# EasyEDA Pro project SuperCapTestBoard - copy - 2 25.eprj (continued)
## Parts (continued)

## Library data of the parts
C1 C2 C10 C14 C21 C22 C25-C33 C36-C43 CFF1 = CAP_0603: Supplier Footprint: 0603
C3 = C_Ele_SMD_3x5.4mm: Supplier Footprint: SMD,3x5.4mm; 耐压: 35V
C4-C9 C12 C13 C16-C20 = C_Ele_SMD_3x5.4mm: Supplier Footprint: SMD,3x5.4mm
C11 C15 C23 C24 = CAP_0201: Supplier Footprint: 0201
CN1-CN3 = XT30U-M: LCSC Part Name: AMASS(艾迈斯)轻量版锂电池插头公头 XT30U-M; Supplier Part: C99101; Manufacturer: AMASS(艾迈斯); JLCPCB Part Class: Extended Part; Datasheet: https://atta.szlcsc.com/upload/public/pdf/source/20170606/1496716542582.pdf; Supplier: LCSC
D1-D4 = 1N4007: Supplier Footprint: DO-41
L1 L2 = L_0603: Supplier Footprint: L0603
Q1-Q6 = NCEP0178AK: Gate Threshold Voltage (Vgs(th)@Id):2.2V@250uA Drain Source Voltage (Vdss): Continuous Drain Current (Id): Power Dissipation (Pd): Type: Drain Source On Resistance (RDS(on)@Vgs,Id):8.5mΩ@10V,39A; LCSC Part Name: N沟道 耐压:100V 电流:78A; Supplier Part: C216784; Manufacturer: NCE(无锡新洁能); Supplier Footprint: TO-252-2(DPAK); JLCPCB Part Class: Extended Part; Datasheet: https://atta.szlcsc.com/upload/public/pdf/source/20180614/C216784_4CC9571F208305EE00914CFFBA9F145C.pdf; Supplier: LCSC; Gate Threshold Voltage (Vgs(th)@Id): 2.2V@250uA; Drain Source On Resistance (RDS(on)@Vgs,Id): 8.5mΩ@10V,39A
R1 R2 R11 = LR2512D-3W-5mR-1%: Type:Current Sensing Resistors Resistance:5mΩ Tolerance:±1% Tolerance:±1% Power(Watts): Temperature Coefficient:25ppm/℃~+50ppm/℃ Temperature Coefficient:25ppm/℃~+50ppm/℃ Mounting Sytle:Surface Mount; LCSC Part Name: 5mΩ ±1% 3W; Supplier Part: C500739; Manufacturer: Milliohm(毫欧); Supplier Footprint: 2512; JLCPCB Part Class: Extended Part; Datasheet: https://atta.szlcsc.com/upload/public/pdf/source/20211008/27BCB003066C6550DC06C87D8395239C.pdf; Supplier: LCSC; Type: Current Sensing Resistors; Tolerance: ±1%; Temperature Coefficient: 25ppm/℃~+50ppm/℃; Mounting Sytle: Surface Mount
R3-R10 R12-R16 R18 R20-R28 R31 R32 = Res_0603: Supplier Footprint: 0603
R17 R19 = Res_0201: Supplier Footprint: 0201
U1 = LM5050MK-1/NOPB: Supplier Part: C129323; Manufacturer: TI(德州仪器); Supplier Footprint: TSOT-23-6; JLCPCB Part Class: Extended Part; Datasheet: https://atta.szlcsc.com/upload/public/pdf/source/20170914/C129323_1505359957620968163.pdf; Supplier: LCSC
U2 U4 = SB1045L_C2844167: Diode Configuration:Single Forward Voltage (Vf@If):400mV@8A Reverse Voltage (Vr):45V Average Rectified Current (Io):10A Reverse Leakage Current (Ir):51uA@45V; LCSC Part Name: 电压:45V 电流:10A; Supplier Part: C2844167; Manufacturer: FUXINSEMI(富芯森美); Supplier Footprint: TO-277B; JLCPCB Part Class: 扩展库; Datasheet: https://atta.szlcsc.com/upload/public/pdf/source/20220513/1E1CA09FD724AFD607AAA472FAD2B52D.pdf; Supplier: LCSC; Diode Configuration: Single; Forward Voltage (Vf@If): 400mV@8A; Reverse Voltage (Vr): 45V; Average Rectified Current (Io): 10A; Reverse Leakage Current (Ir): 51uA@45V
U3 U5 = UCC27284QDRQ1: Driven Configuration:Half Bridge Number of Drivers:2 Load Type:MOSFET Supply Voltage:5.5V~16V Supply Voltage:5.5V~16V Peak Output Current(sink):3.5A Peak Output Current(source):2.5A Rise Time:12ns Fall Time:10ns Operating Temperature:-40℃~+125℃ Operating; LCSC Part Name: 半桥 MOSFET 灌电流3.5A 拉电流2.5A; Supplier Part: C3654891; Manufacturer: TI(德州仪器); Supplier Footprint: SOIC-8; JLCPCB Part Class: 扩展库; Supplier: LCSC; Driven Configuration: Half Bridge; Number of Drivers: 2; Load Type: MOSFET; Supply Voltage: 5.5V~16V; Peak Output Current(sink): 3.5A; Peak Output Current(source): 2.5A; Rise Time: 12ns; Fall Time: 10ns; Operating Temperature: -40℃~+125℃
C34 C35 = TAJA106K016RNJ: Capacitance: Tolerance:±10% Tolerance:±10% Rated Voltage: Equivalent Series Resistance(ESR):3Ω@100kHz Operating Temperature:-55℃~+125℃ Operating Temperature:-55℃~+125℃; LCSC Part Name: 10uF ±10% 16V; Supplier Part: C7171; Manufacturer: Kyocera AVX; Supplier Footprint: CASE-A-3216; JLCPCB Part Class: 基础库; Datasheet: https://atta.szlcsc.com/upload/public/pdf/source/20160107/1457707748093.pdf; Supplier: LCSC; Tolerance: ±10%; Equivalent Series Resistance(ESR): 3Ω@100kHz; Operating Temperature: -55℃~+125℃
D5 = D_1N4007: Supplier Footprint: SMA
U6 = SY8501FCC: Supplier Part: C365714; Manufacturer: silergy(矽力杰); Supplier Footprint: SO-8-EP; JLCPCB Part Class: 扩展库; Datasheet: https://atta.szlcsc.com/upload/public/pdf/source/20190322/C365714_219A6278F83EB450AA6BA842D4F40851.pdf; Supplier: LCSC
U7 = LM1117DTX-3.3/NOPB: Supplier Part: C78471; Supplier Footprint: TO-252-2(DPAK); JLCPCB Part Class: 扩展库; Datasheet: https://atta.szlcsc.com/upload/public/pdf/source/20160718/1468827476469.pdf; Supplier: LCSC
H1 H3-H8 = HDR-F_2.54_1x2P: Supplier Footprint: Through
H2 = HDR-F_2.54_1x2P: Supplier Part: C49661; Supplier Footprint: 插件
L3 = L_0805
R29 = Res_0603: V_bat; Supplier Footprint: 0603
R30 = Res_0603: V_cap; Supplier Footprint: 0603
U8 U10 = INA181A1IDBVT: I_Left; Supplier Part: C2861997; Manufacturer: TI(德州仪器); Supplier Footprint: SOT-23-6; JLCPCB Part Class: 扩展库; Supplier: LCSC
U9 = INA181A1IDBVT: I_Right; Supplier Part: C2861997; Manufacturer: TI(德州仪器); Supplier Footprint: SOT-23-6; JLCPCB Part Class: 扩展库; Supplier: LCSC
U11 = TLV521DCKR: 1V65 Op_amp; Supplier Part: C655085; Manufacturer: TI(德州仪器); Supplier Footprint: SC-70-5; JLCPCB Part Class: 扩展库; Datasheet: https://atta.szlcsc.com/upload/public/pdf/source/20230221/E2B5CB4AD3C2600A011813BFD55EDD6A.pdf; Supplier: LCSC

## Nets
1V65: C41.1 C42.1 C43.1 U8.5(REF) U9.5(REF) U10.5(REF) U11.1(OUT) U11.4(IN-)
3V3: C35.1 L3.1 U7.2(OUT)
12V: C1.2 C14.2 C30.2 C31.2 C32.2 C34.1 CFF1.2 D5.2(A) L2.2 R17.2 R19.2 R24.2 U3.1(VDD) U5.1(VDD) U7.3(IN)
24V: C26.2 C27.2 C28.2 CN2.1 R11.2 R23.1 R25.2 U6.2(IN) U8.3(IN+)
GND: C1.1 C3.2 C4.2 C5.2 C6.2 C7.2 C8.2 C9.2 C11.2 C12.2 C13.2 C14.1 C15.2 C16.2 C17.2 C18.2 C19.2 C20.2 C23.2 C24.2 C26.1 C27.1 C28.1 C29.1 C30.1 C31.1 C32.1 C33.2 C34.2 C35.2 C36.2 C37.2 C38.2 C39.2 C40.2 C41.2 C42.2 C43.2 CN1.2 CN2.2 CN3.2 H1.2 H2.1 H2.2 H3.2 H4.2 H5.2 H8.2 Q5.3(S) Q6.3(S) R14.1 R15.1 R16.2 R26.1 R28.1 R31.1 R32.1 U1.2(GND) U3.7(VSS) U5.7(VSS) U6.9(GND) U7.1(GND) U8.2(GND) U9.2(GND) U10.2(GND) U11.2(V-)
ADC12_IN0: H1.1 U8.1(OUT)
ADC12_IN1: H3.1 U10.1(OUT)
ADC12_IN2: H4.1 U9.1(OUT)
ADC12_IN3: H5.1 R29.1 R31.2
ADC12_IN4: H8.1 R30.1 R32.2
ChassisPower: CN1.1 Q3.4(D) Q4.4(D) R1.2 R29.2 U1.1(VS) U1.6(OUT) U10.3(IN+)
DCDCOutput-CAP: CN3.1 R2.2 R30.2 U9.3(IN+)
I_Bat_TP_L: C3.1 C4.1 C5.1 C6.1 C7.1 C8.1 C9.1 Q1.4(D) R1.1 U10.4(IN-)
I_Cap_TP_L: C12.1 C13.1 C16.1 C17.1 C18.1 C19.1 C20.1 Q2.4(D) R2.1 U9.4(IN-)
I_Sys_TP_L: Q3.3(S) Q4.3(S) R11.1 U1.4(IN) U8.4(IN-)
LHG: R3.1 R5.1 U5.3(HO)
LHG_Control: H7.1 R22.2
LHGND: C21.2 C22.2 L1.1 Q1.3(S) Q5.4(D) R7.1 U5.4(HS)
LLG: R9.1 R12.1 U5.8(LO)
LLG_Control: H7.2 R21.2
REF3V3: C36.1 C37.1 C38.1 C39.1 L3.2 R27.2 U8.6(VS) U9.6(VS) U10.6(VS) U11.5(V+)
RHG: R4.1 R6.1 U3.3(HO)
RHG_Control: H6.1 R20.2
RHGND: C2.2 C10.2 L1.2 Q2.3(S) Q6.4(D) R8.1 U3.4(HS)
RLG: R10.1 R13.1 U3.8(LO)
RLG_Control: H6.2 R18.2
$1N1327: R16.1 U1.3(OFF)
$1N6258: D1.1(K) R3.2
$1N6388: D1.2(A) Q1.1(G) R5.2 R7.2
$1N6557: D3.1(K) R9.2
$1N6577: D3.2(A) Q5.1(G) R12.2 R14.2
$1N6908: D2.1(K) R4.2
$1N6911: D4.1(K) R10.2
$1N6922: D2.2(A) Q2.1(G) R6.2 R8.2
$1N6941: D4.2(A) Q6.1(G) R13.2 R15.2
$1N7206: C11.1 R18.1 U3.6(LI)
$1N7273: C15.1 R20.1 U3.5(HI)
$1N7440: C23.1 R21.1 U5.6(LI)
$1N7452: C24.1 R22.1 U5.5(HI)
$1N7629: Q3.1(G) Q4.1(G) U1.5(GATE)
$1N10834: C2.1 C10.1 U2.2 U3.2(HB)
$1N10869: C21.1 C22.1 U4.2 U5.2(HB)
$1N10964: R19.1 U4.1 U4.3
$1N11017: R17.1 U2.1 U2.3
$2N706: C25.1 U6.7(BS)
$2N707: C29.2 R23.2 U6.3(EN)
$2N709: C33.1 D5.1(K) U6.6(VCC)
$2N715: R25.1 U6.4(RON)
$2N718: C25.2 L2.1 U6.8(LX)
$2N719: CFF1.1 R24.1 R26.2 U6.5(FB)
$3N6491: C40.1 R27.1 R28.2 U11.3(IN+)

Not connected (* = marked no-connect by the designer): U6 1(NC)*

## Notes on the sheets
sheet 1
- Estimation Power in this resistor: 1W
  Max current: 10A -10A
- Estimation Power in this resistor: 2W
  Max current: 15A -15A
- Estimation Power in this resistor: 1W
  Max current: 10A
- change to 220nF & 2R2 in the test board
sheet 2
- Input 24V
- Change to 10k and 91k
- DC voltage for C is 35
- Power
- 24V -DCDC-> 12V -LDO-> 5V -LDO-> 3V3
- Output current ?
- Output 12V
- The C will be change to low ESR
- The C will be change to low ESR
- This page leave for MCU (STM32F4)
sheet 3
- GPIO and GND
- -15A to 15A , typ 0A -> 0.075Vto-0.075V
- 0.075Vto-0.075V  ===>  *20+1.65
- 0.05Vto-0.05V  ===>   *20+1.65
- 0 to 30V, typ 24V
- 0 to 30V, typ 24V

# Board PCB1
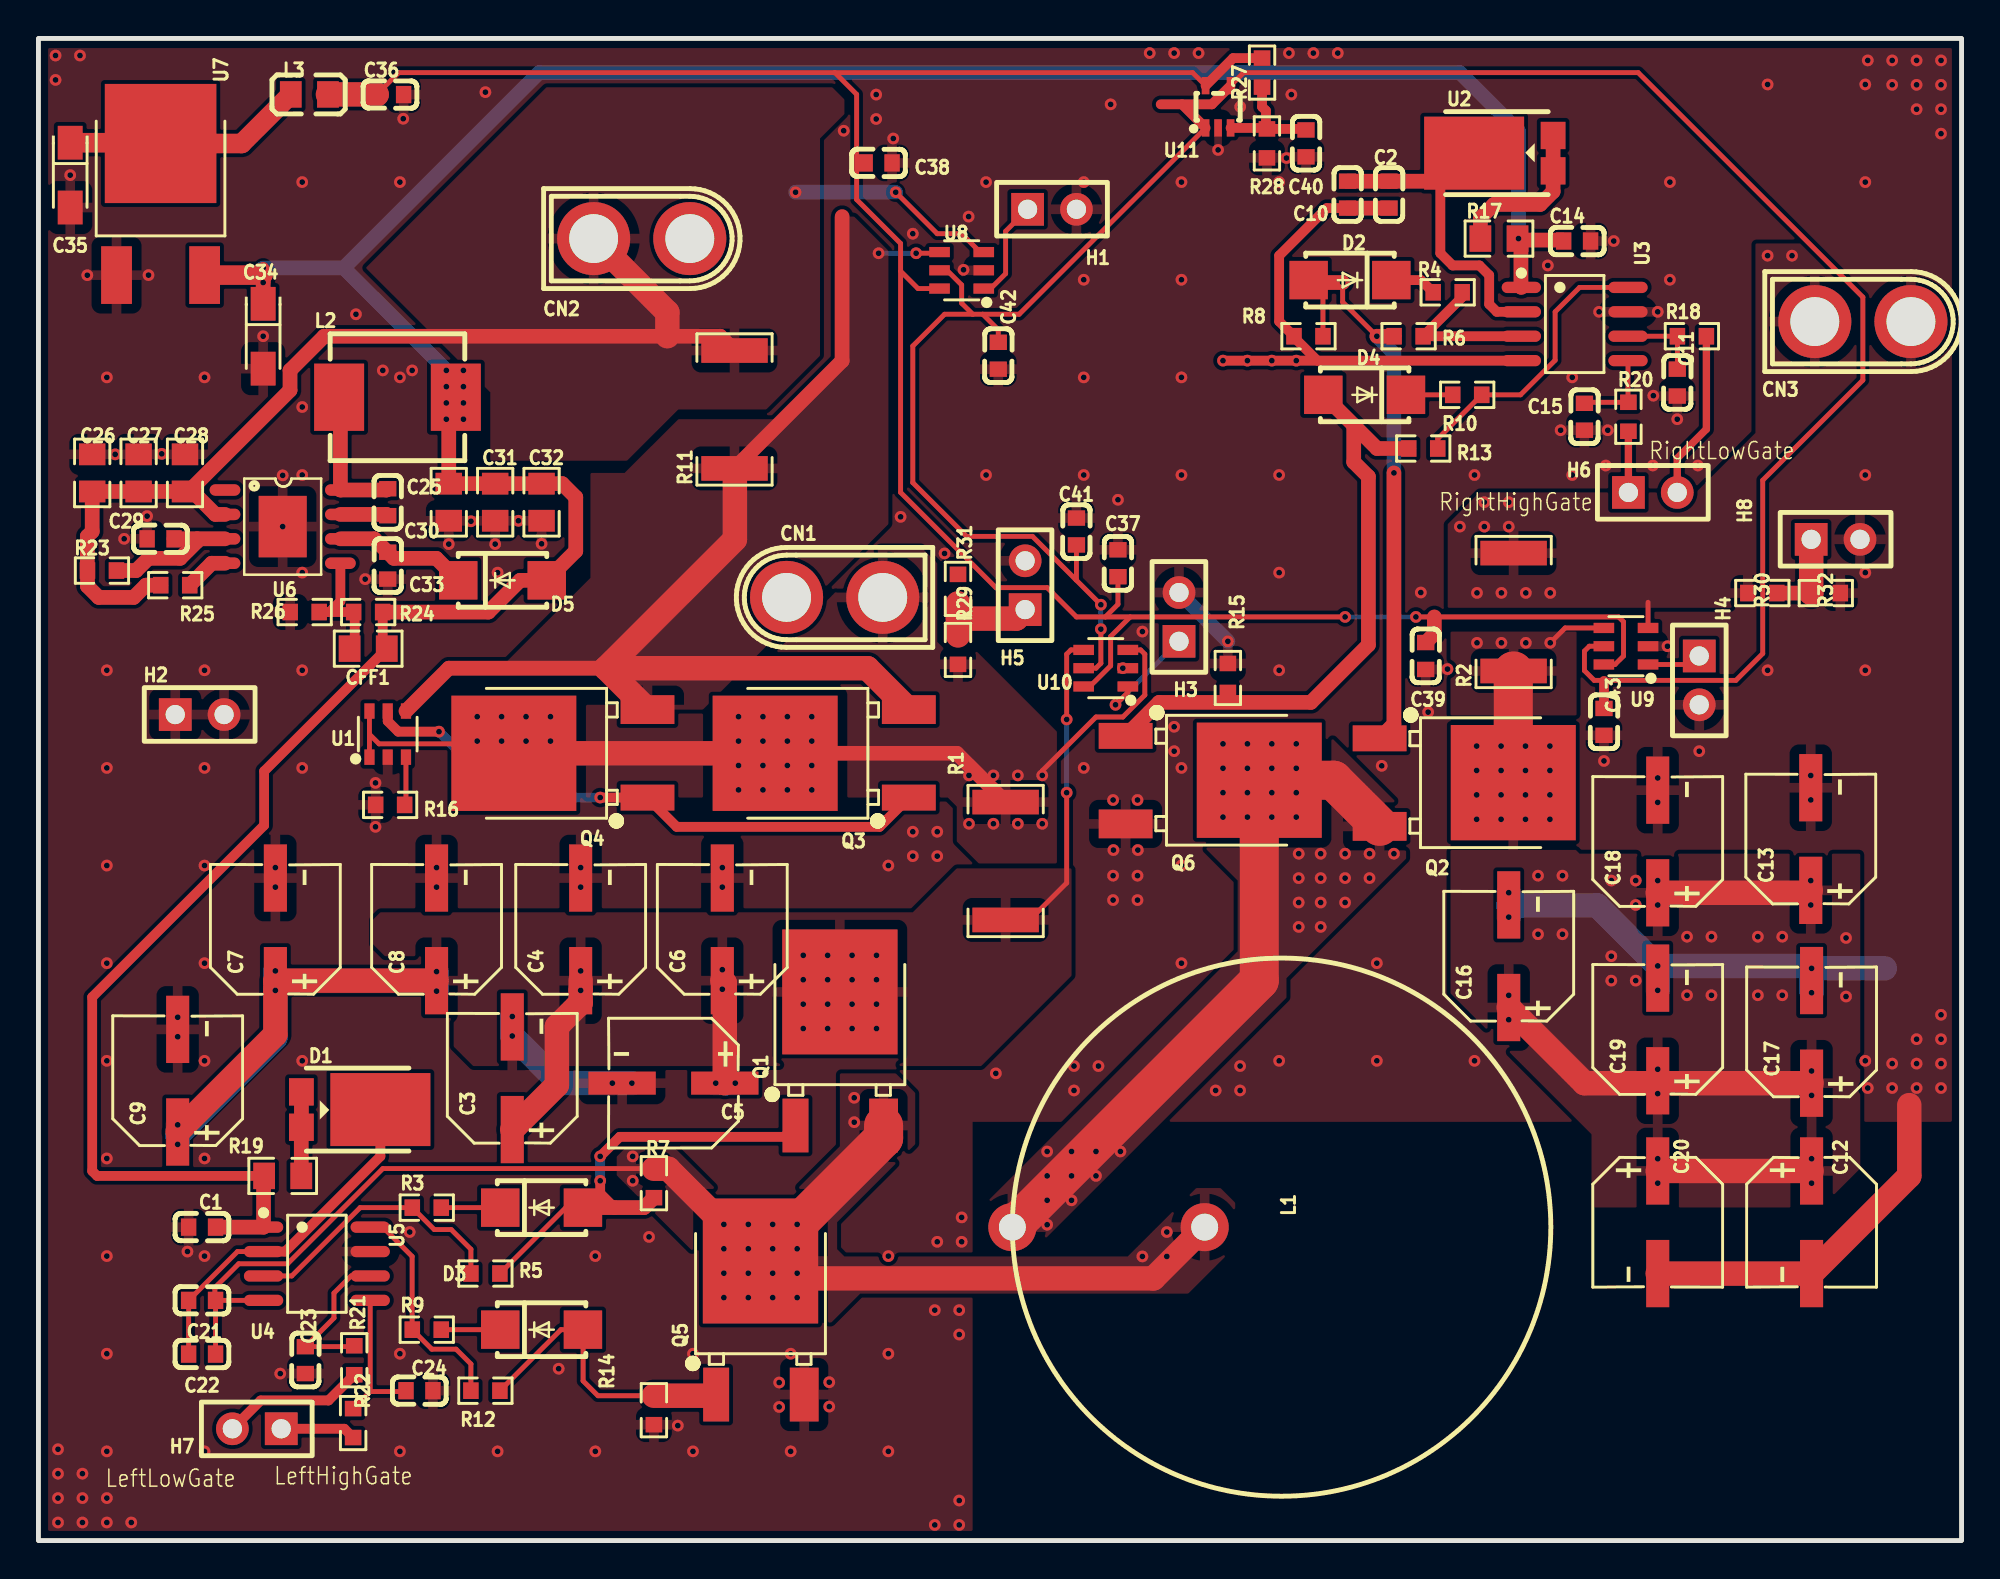
[diagram p3: board, top side]
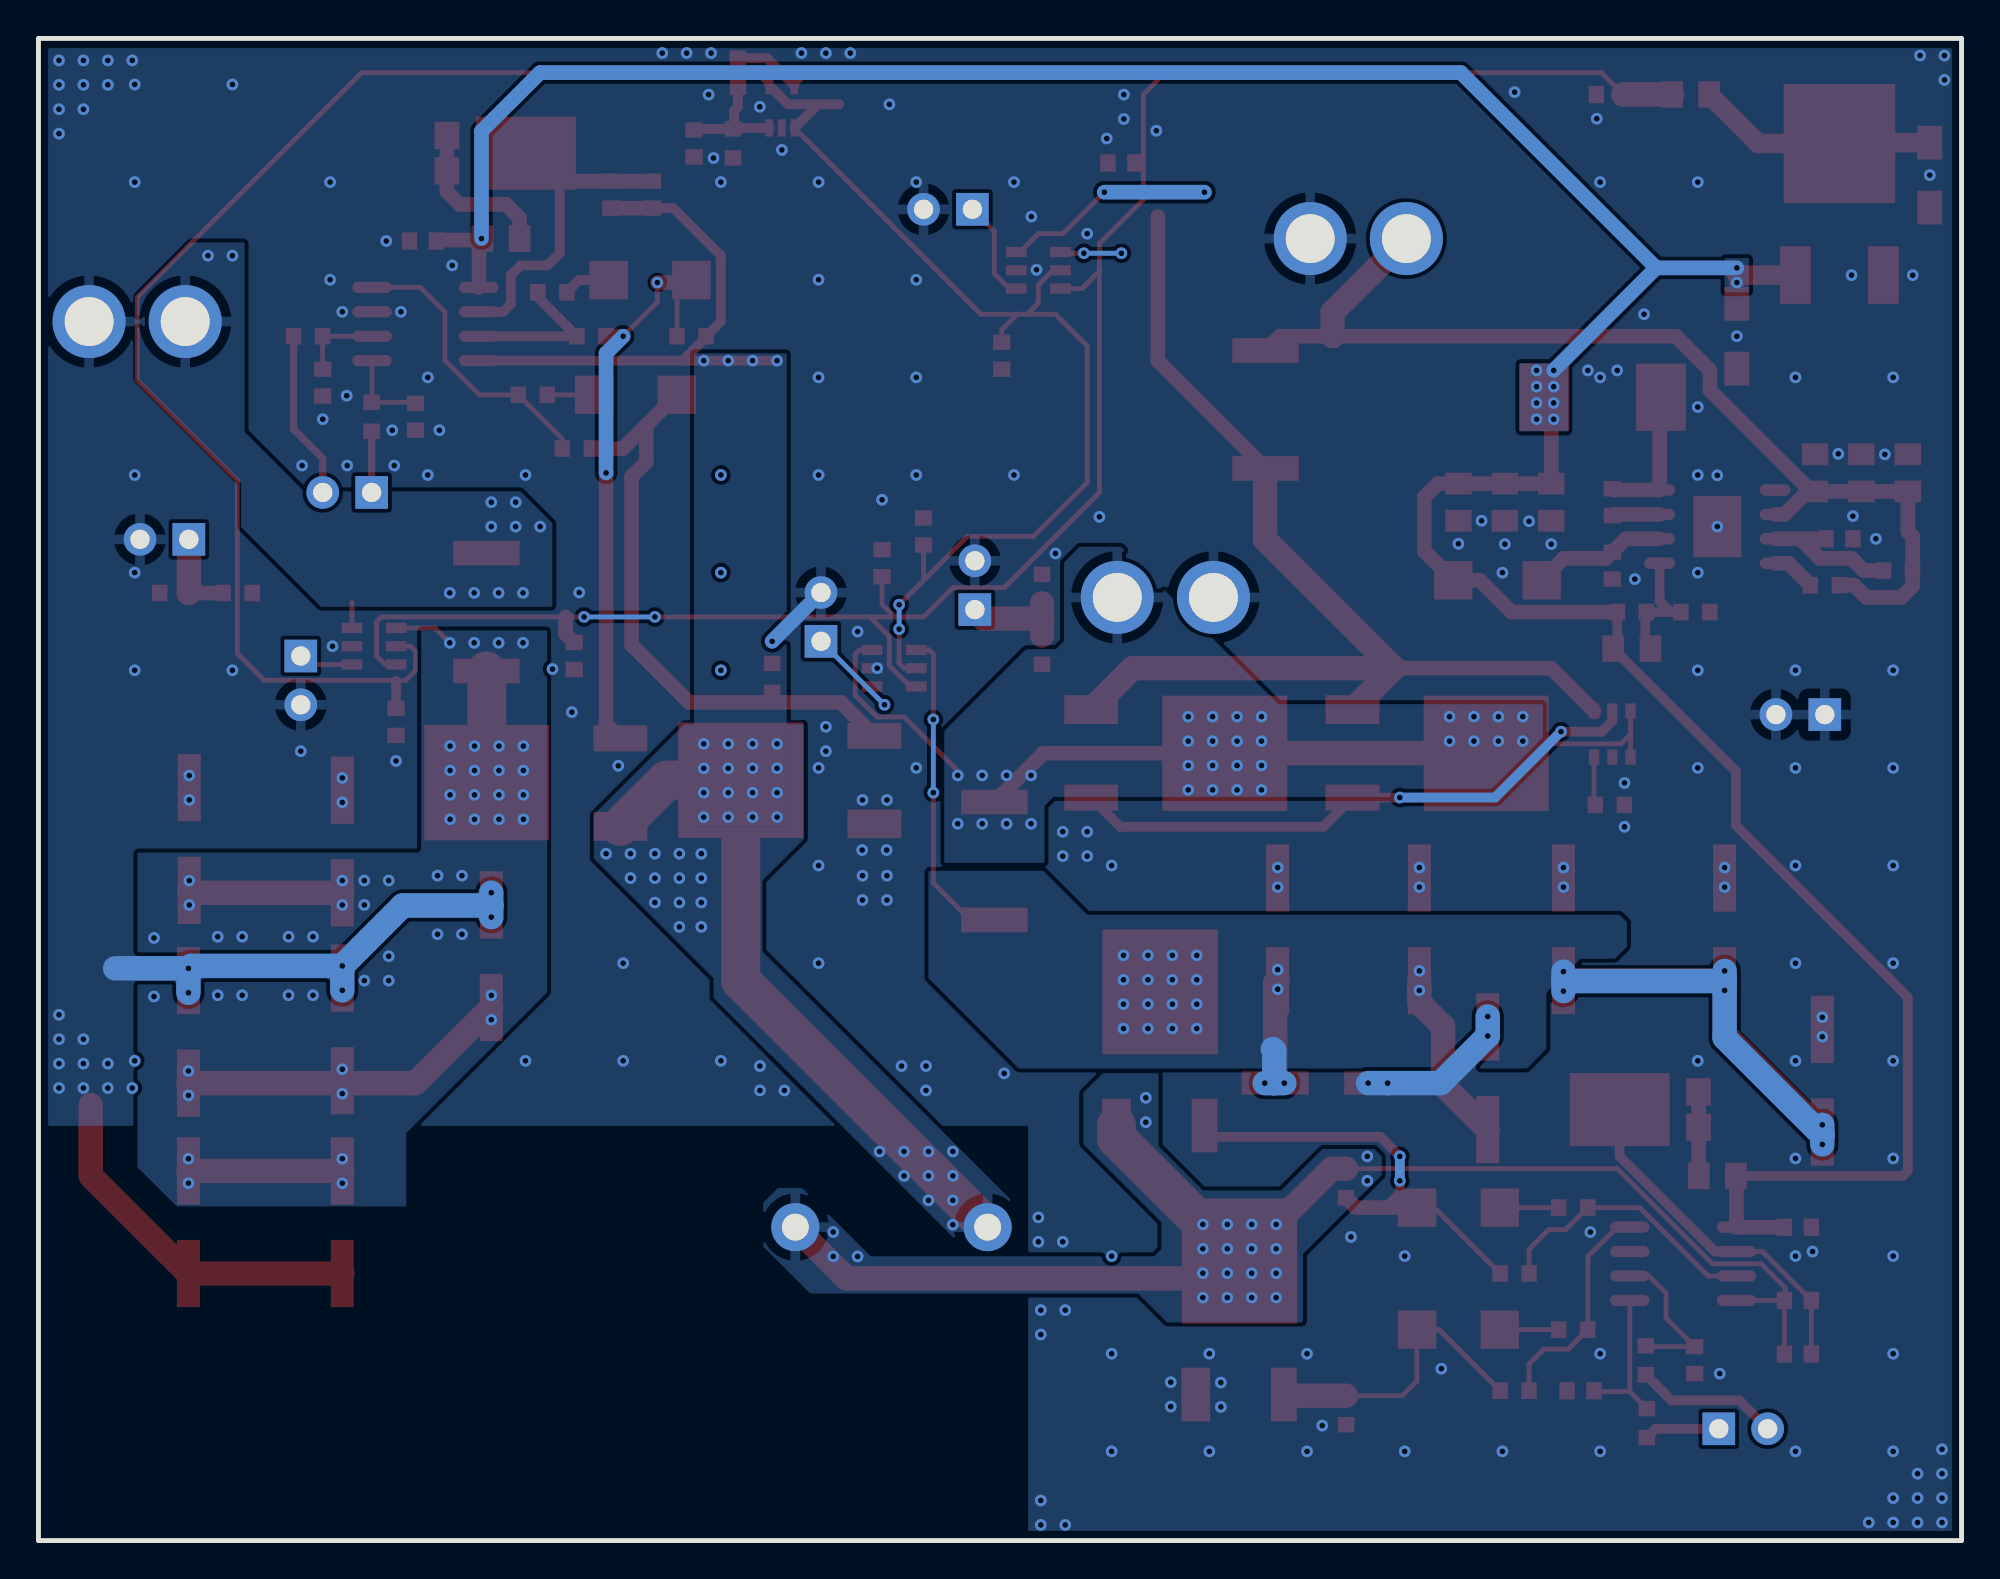
[diagram p4: board, bottom side, seen from below]

Outline 100 x 78.16 mm; copper layers: Top Layer, Bottom Layer. Coordinates in mm from the lower left corner of the outline.
Outline path: rectangle 0,78.16 100,0
Stack: Top Layer 0.035mm / Dielectric1 1.51mm FR4 er 4.5 / Bottom Layer 0.035mm

## Design rules (mm)
template: 自定义配置
spacing copperThickness1oz (default): track to track 0.102, other pairs 0.152 to 0.3
spacing copperThickness2oz: track to track 0.203, other pairs 0.152 to 0.3
track width copperThickness1oz (default): min 0.127, default 0.254, max 2.54
track width copperThickness2oz: min 0.203, default 0.254, max 2.54
differential pair differentialPair (default): width min 0.127, default 0.254, max 2.54; gap min 0.152, default 0.152
via viaSize (default): diameter min 0.5, default 0.61, max 10; hole min 0.3, default 0.305, max 6.3
pour e3320 uses copperRegion

## Placement (name value [footprint] x y rotation side)
C1  4.7uF  [C0603]  8.51 16.31 0 top
C2  220nF  [C0603]  70.23 70.03 270 top
C3  47uF  [CAP-SMD_BD6.3-L6.6-W6.6-LS7.2-FD-1]  24.64 24.05 90 top
C4  47uF  [CAP-SMD_BD6.3-L6.6-W6.6-LS7.2-FD-1]  28.19 31.8 90 top
C5  47uF  [CAP-SMD_BD6.3-L6.6-W6.6-LS7.2-FD-1]  33.02 23.8 180 top
C6  47uF  [CAP-SMD_BD6.3-L6.6-W6.6-LS7.2-FD-1]  35.56 31.8 90 top
C7  100nF  [CAP-SMD_BD6.3-L6.6-W6.6-LS7.2-FD-1]  12.32 31.8 90 top
C8  100nF  [CAP-SMD_BD6.3-L6.6-W6.6-LS7.2-FD-1]  20.7 31.8 90 top
C9  100nF  [CAP-SMD_BD6.3-L6.6-W6.6-LS7.2-FD-1]  7.24 23.93 90 top
C10  220nF  [C0603]  68.07 70.03 270 top
C11  100nF  [C0603]  85.22 60.25 270 top
C12  100nF  [CAP-SMD_BD6.3-L6.6-W6.6-LS7.2-FD-1]  92.2 16.56 270 top
C13  100nF  [CAP-SMD_BD6.3-L6.6-W6.6-LS7.2-FD-1]  92.16 36.5 90 top
C14  4.7uF  [C0603]  80.01 67.62 180 top
C15  100nF  [C0603]  80.39 58.47 270 top
C16  47uF  [CAP-SMD_BD6.3-L6.6-W6.6-LS7.2-FD-1]  76.45 30.4 90 top
C17  47uF  [CAP-SMD_BD6.3-L6.6-W6.6-LS7.2-FD-1]  92.2 26.47 90 top
C18  47uF  [CAP-SMD_BD6.3-L6.6-W6.6-LS7.2-FD-1]  84.2 36.37 90 top
C19  47uF  [CAP-SMD_BD6.3-L6.6-W6.6-LS7.2-FD-1]  84.2 26.59 90 top
C20  100nF  [CAP-SMD_BD6.3-L6.6-W6.6-LS7.2-FD-1]  84.2 16.56 270 top
C21  220nF  [C0603]  8.51 12.5 0 top
C22  220nF  [C0603]  8.51 9.7 0 top
C23  100nF  [C0603]  13.88 9.39 270 top
C24  100nF  [C0603]  19.81 7.8 0 top
C25  100nF  [C0603]  18.16 54.03 90 top
C26  99F  [R0805_NEW]  2.79 55.55 270 top
C27  10uF  [R0805_NEW]  5.21 55.55 270 top
C28  1uF  [R0805_NEW]  7.62 55.55 270 top
C29  1uF  [C0603]  6.35 52.12 0 top
C30  10uF  [R0805_NEW]  21.34 54.03 90 top
C31  10uF  [R0805_NEW]  23.75 54.03 90 top
C32  10uF  [R0805_NEW]  26.16 54.03 90 top
C33  100nF  [C0603]  18.16 50.72 270 top
C34  10uF  [CAP-SMD_L3.2-W1.6-RD-C7171]  11.68 62.66 270 top
C35  10uF  [CAP-SMD_L3.2-W1.6-RD-C7171]  1.65 71.04 270 top
C36  100nF  [C0603]  18.29 75.23 0 top
C37  100nF  [C0603]  56.13 50.85 90 top
C38  100nF  [C0603]  43.69 71.68 0 top
C39  100nF  [C0603]  72.14 46.03 270 top
C40  100nF  [C0603]  65.91 72.7 270 top
C41  100nF  [C0603]  53.97 52.5 90 top
C42  100nF  [C0603]  49.91 61.65 270 top
C43  100nF  [C0603]  81.41 42.6 270 top
CFF1  50pF  [R0805_NEW]  17.14 46.41 0 top
CN1  ChassisConnector  [CONN-TH_XT30U-M]  41.4 49.07 180 top
CN2  PowerInput  [CONN-TH_XT30U-M]  31.37 67.74 0 top
CN3  CAPConnector  [CONN-TH_XT30U-M]  94.87 63.42 0 top
D1  D_oddLHi  [DO-214AC_L4.3-W2.4-LS4.7-RD]  26.16 17.32 0 top
D2  D_oddRHi  [DO-214AC_L4.3-W2.4-LS4.7-RD]  68.2 65.58 180 top
D3  D_oddLLo  [DO-214AC_L4.3-W2.4-LS4.7-RD]  26.16 10.97 0 top
D4  D_oddRLo  [DO-214AC_L4.3-W2.4-LS4.7-RD]  68.96 59.61 180 top
D5  -  [do-214ac_l4.3-w2.7-ls5.2-rd]  24.13 49.96 0 top
H1  -  [HDR-TH_2P-P2.54-V-F]  52.71 69.27 0 top
H2  -  [HDR-TH_2P-P2.54-V-F]  8.38 42.98 0 top
H3  -  [HDR-TH_2P-P2.54-V-F]  59.31 48.06 90 top
H4  -  [HDR-TH_2P-P2.54-V-F]  86.36 44.76 270 top
H5  -  [HDR-TH_2P-P2.54-V-F]  51.31 49.71 90 top
H6  -  [HDR-TH_2P-P2.54-V-F]  83.95 54.53 0 top
H7  -  [HDR-TH_2P-P2.54-V-F]  11.35 5.82 180 top
H8  -  [HDR-TH_2P-P2.54-V-F]  93.45 52.09 0 top
L1  40uH  [Inductor 080125]  64.64 16.31 270 top
L2  10uH  [ind-smd_l7.0-w6.6_cmkd-0630a]  18.67 59.49 0 top